# EasyEDA Pro project hardware.eprj, schematic Schematic2
Create Date: 2022-11-15; Page Name: P1; Project Name: SCH_tc264_2022-07-02; Schematic Name: Schematic2; Update Date: 2022-12-05; Company: 嘉立创EDA; Page Size: A3; Version: V1.0
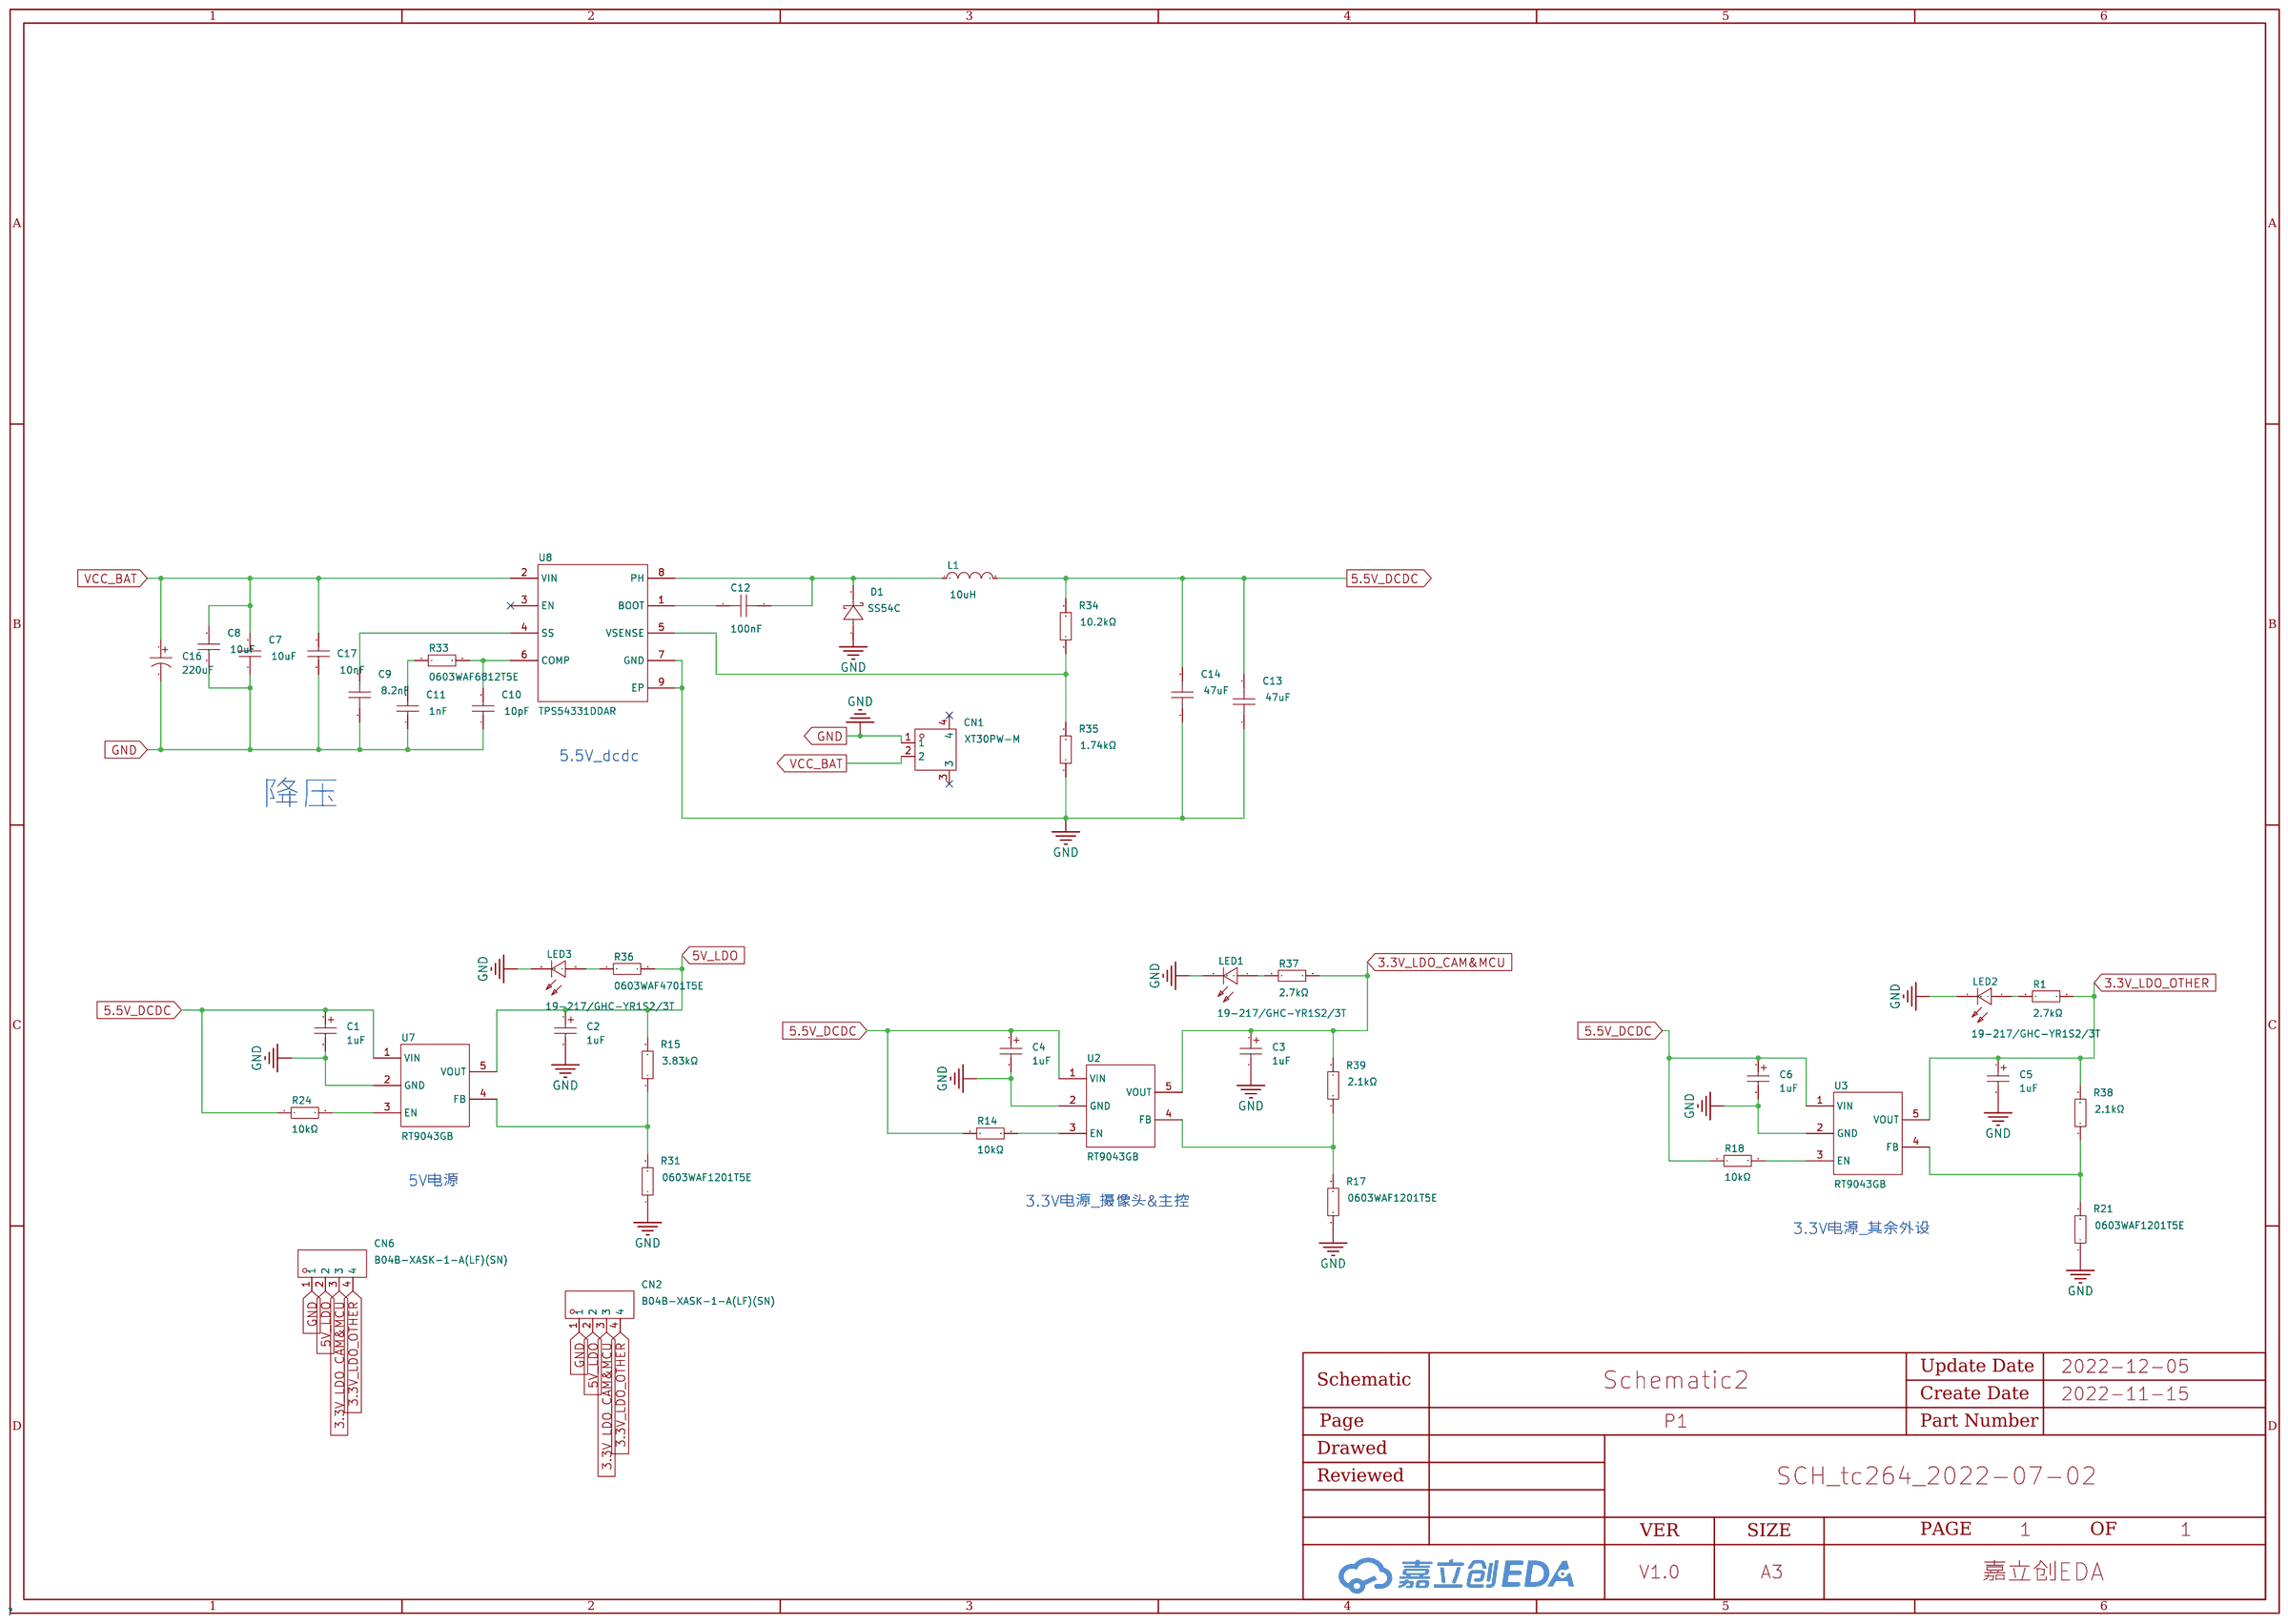
[diagram p2: schematic sheet]

## Parts
C1  1uF  [CAP-SMD_L3.2-W1.6-RD]
C2  1uF  [CAP-SMD_L3.2-W1.6-RD]
C3  1uF  [CAP-SMD_L3.2-W1.6-RD]
C4  1uF  [CAP-SMD_L3.2-W1.6-RD]
C5  1uF  [CAP-SMD_L3.2-W1.6-RD]
C6  1uF  [CAP-SMD_L3.2-W1.6-RD]
C7  10uF  [C1206]
C8  10uF  [C1206]
C9  8.2nF  [C0603]
C10  10pF  [C0402]
C11  1nF  [C0603]
C12  100nF  [C0603]
C13  47uF  [C1206]
C14  47uF  [C1206]
C16  220uF  [CAP-TH_BD10.0-P5.00-D1.0-FD]
C17  10nF  [C0603]
CN1  XT30PW-M  [CONN-TH_XT30PW-M]
CN2  B04B-XASK-1-A(LF)(SN)  [CONN-TH_B04B-XASK-1-A-LF-SN]
CN6  B04B-XASK-1-A(LF)(SN)  [CONN-TH_B04B-XASK-1-A-LF-SN]
D1  SS54C  [SMC_L6.9-W5.9-LS7.9-R-RD]
L1  10uH  [IND-SMD_L11.5-W10.0_SMMS1040]
LED1  19-217/GHC-YR1S2/3T  [LED0603-R-RD]
LED2  19-217/GHC-YR1S2/3T  [LED0603-R-RD]
LED3  19-217/GHC-YR1S2/3T  [LED0603-R-RD]
R1  2.7kΩ  [R0603]
R14  10kΩ  [R0603]
R15  3.83kΩ  [R0603]
R17  0603WAF1201T5E  [R0603]
R18  10kΩ  [R0603]
R21  0603WAF1201T5E  [R0603]
R24  10kΩ  [R0603]
R31  0603WAF1201T5E  [R0603]
R33  0603WAF6812T5E  [R0603]
R34  10.2kΩ  [R0603]
R35  1.74kΩ  [R0603]
R36  0603WAF4701T5E  [R0603]
R37  2.7kΩ  [R0603]
R38  2.1kΩ  [R0603]
R39  2.1kΩ  [R0603]
U2  RT9043GB  [SOT-23-5_L3.0-W1.7-P0.95-LS2.8-BR]
U3  RT9043GB  [SOT-23-5_L3.0-W1.7-P0.95-LS2.8-BR]
U7  RT9043GB  [SOT-23-5_L3.0-W1.7-P0.95-LS2.8-BR]
U8  TPS54331DDAR  [SOIC-8_L5.0-W4.0-P1.27-LS6.0-BL-EP2.0]

## Library data of the parts
C1-C6 = TAJA105K016RNJ: 容值:1uF;精度:±10%;额定电压:16V;等效串联电阻:-;工作温度:-55~+125;; LCSC Part Name: 1uF ±10% 16V; Supplier Part: C7174; Manufacturer: Kyocera AVX; Supplier Footprint: CASE-A_3216; JLCPCB Part Class: Extended Part; Datasheet: https://atta.szlcsc.com/upload/public/pdf/source/20160107/1457707748219.pdf; Supplier: LCSC; Tolerance: ±10%; Rated Voltage: 16V; Operating Temperature: -55~+125
C7 C8 = CL31A106KBHNNNE: 容值:10uF;精度:±10%;额定电压:50V;材质(温度系数):X5R;; LCSC Part Name: 10uF ±10% 50V; Supplier Part: C13585; Manufacturer: SAMSUNG(三星); Supplier Footprint: 1206; JLCPCB Part Class: Basic Part; Datasheet: https://atta.szlcsc.com/upload/public/pdf/source/20160103/1457707668742.pdf; Supplier: LCSC; Tolerance: ±10%; Voltage Rated: 50V; Temperature Coefficient: X5R
C9 = CC0603KRX7R9BB822: 容值:8.2nF;精度:±10%;额定电压:50V;材质(温度系数):X7R;; LCSC Part Name: 8.2nF ±10% 50V; Supplier Part: C113812; Manufacturer: YAGEO(国巨); Supplier Footprint: 0603; JLCPCB Part Class: Extended Part; Datasheet: https://atta.szlcsc.com/upload/public/pdf/source/20170602/1496384445452.pdf; Supplier: LCSC; Tolerance: ±10%; Voltage Rated: 50V; Temperature Coefficient: X7R
C10 = CC0402JRNPO9BN100: 容值:10pF;精度:±5%;额定电压:50V;材质(温度系数):NP0;; LCSC Part Name: 10pF ±5% 50V; Supplier Part: C106199; Manufacturer: YAGEO(国巨); Supplier Footprint: 0402; JLCPCB Part Class: Extended Part; Datasheet: https://atta.szlcsc.com/upload/public/pdf/source/20170518/1495085708228.pdf; Supplier: LCSC; Tolerance: ±5%; Voltage Rated: 50V; Temperature Coefficient: NP0
C11 = CC0603KRX7R9BB102: 容值:1nF;精度:±10%;额定电压:50V;材质(温度系数):X7R;; LCSC Part Name: 1nF ±10% 50V; Supplier Part: C100040; Manufacturer: YAGEO(国巨); Supplier Footprint: 0603; JLCPCB Part Class: Extended Part; Datasheet: https://atta.szlcsc.com/upload/public/pdf/source/20170420/1492670664651.pdf; Supplier: LCSC; Tolerance: ±10%; Voltage Rated: 50V; Temperature Coefficient: X7R
C12 = CC0603KRX7R9BB104: 容值:100nF;精度:±10%;额定电压:50V;材质(温度系数):X7R;; LCSC Part Name: 100nF ±10% 50V; Supplier Part: C14663; Manufacturer: YAGEO(国巨); Supplier Footprint: 0603; JLCPCB Part Class: Basic Part; Datasheet: https://atta.szlcsc.com/upload/public/pdf/source/20170116/1484561234239.pdf; Supplier: LCSC; Tolerance: ±10%; Voltage Rated: 50V; Temperature Coefficient: X7R
C13 C14 = GRM31CR61A476ME15L: 容值:47uF;精度:±20%;额定电压:10V;温度系数:X5R;; LCSC Part Name: 47uF 10V; Supplier Part: C94034; Manufacturer: muRata(村田); Supplier Footprint: 1206; JLCPCB Part Class: Extended Part; Datasheet: https://atta.szlcsc.com/upload/public/pdf/source/20170310/1489116302849.pdf; Supplier: LCSC; Tolerance: ±20%; Voltage Rated: 10V; Temperature Coefficient: X5R
C16 = KM227M050G13RR0VH2FP0: 容值:220uF;脚间距:5mm;纹波电流:-;额定电压:50V;等效串联电阻:-;精度:±20%;工作寿命:2000hrs 105;电容体直径:10mm;工作温度:-;电容体长度:13mm;; LCSC Part Name: 220uF 50V; Supplier Part: C45105; Manufacturer: CX(承兴); Supplier Footprint: 径向引线,10x13mm; JLCPCB Part Class: Extended Part; Datasheet: https://atta.szlcsc.com/upload/public/pdf/source/20151029/1457707529682.pdf; Supplier: LCSC; Lead Spacing: 5mm; Rated Voltage: 50V; Tolerance: ±20%; Lifetime @ Temp: 2000hrs 105; φD: 10mm; L: 13mm
C17 = CC0603KRX7R9BB103: 容值:10nF;精度:±10%;额定电压:50V;材质(温度系数):X7R;; LCSC Part Name: 10nF ±10% 50V; Supplier Part: C100042; Manufacturer: YAGEO(国巨); Supplier Footprint: 0603; JLCPCB Part Class: Extended Part; Datasheet: https://atta.szlcsc.com/upload/public/pdf/source/20180326/C100042_E8B0111D51DE3671A0A4A59FBCEFE81C.pdf; Supplier: LCSC; Tolerance: ±10%; Voltage Rated: 50V; Temperature Coefficient: X7R
CN1 = XT30PW-M: Socket,DCsupply,XT30,male,PIN:2; LCSC Part Name: XT30PW-M公头; Supplier Part: C431092; Manufacturer: AMASS(艾迈斯); Supplier Footprint: Through Hole; JLCPCB Part Class: Extended Part; Datasheet: https://atta.szlcsc.com/upload/public/pdf/source/20220222/6A9F22F7850E25B33E1BE430ADF8560B.pdf; Supplier: LCSC
CN2 CN6 = B04B-XASK-1-A(LF)(SN): 参考系列:XA;间距:2.5mm;插针结构:1x4P;排数:1;每排PIN数:4;行距:-;公母:公型插针;安装方式:直插;额定电流:3A;工作温度范围:-25~+85;; LCSC Part Name: 4P 脚距2.5mm; Supplier Part: C491709; Manufacturer: JST; Supplier Footprint: 插件,P=2.5mm; JLCPCB Part Class: Extended Part; Datasheet: https://atta.szlcsc.com/upload/public/pdf/source/20200416/C514162_2DCD7D1CD2019D14145B8FEA1B6236C2.pdf; Supplier: LCSC; Reference Series: XA; Pitch: 2.5mm; Pins Structure: 1x4P; Number of Rows: 1; Number of PINs Per Row: 4; Gender: 公型插针; Mounting Style: 直插; Current Rating (Max): 3A; Operating Temperature Range: -25~+85
D1 = SS54C_C908244: 二极管配置:独立式;直流反向耐压(Vr):40V;平均整流电流(Io):5A;正向压降(Vf):550mV@5A;反向电流(Ir):500uA@40V;; LCSC Part Name: 40V 5A 550mV@5A; Supplier Part: C908244; Manufacturer: FUXINSEMI(富芯森美); Supplier Footprint: SMC(DO-214AB); JLCPCB Part Class: Extended Part; Datasheet: https://atta.szlcsc.com/upload/public/pdf/source/20201027/C908242_77C8A81B3EBE52B4332ED1F80CC85D97.pdf; Supplier: LCSC; Diode Configuration: 独立式; Reverse Voltage (Vr): 40V; Average Rectified Current (Io): 5A; Forward Voltage (Vf@If): 550mV@5A; Reverse Leakage Current (Ir): 500uA@40V
L1 = MWSA1004S-100MT: 精度:±20%;直流电阻(DCR):30mΩ;额定电流:7.8A;电感值:10uH;; LCSC Part Name: 10uH ±20%; Supplier Part: C408487; Manufacturer: Sunlord(顺络); Supplier Footprint: SMD; JLCPCB Part Class: Extended Part; Datasheet: https://atta.szlcsc.com/upload/public/pdf/source/20190729/C408487_10B27C975B2F63C7424A4B34DD502902.pdf; Supplier: LCSC; Tolerance: ±20%; DC Resistance (DCR): 30mΩ; Height: 4mm; Rated Current: 7.8A; Width: 11.5mm; Length: 10mm
LED1-LED3 = 19-217/GHC-YR1S2/3T: 照明颜色:翠绿;色温 - CCT（K）:-;主波长/色坐标:520~535nm;; LCSC Part Name: 翠绿LED; Supplier Part: C72043; Manufacturer: EVERLIGHT(台湾亿光); Supplier Footprint: 0603; JLCPCB Part Class: Basic Part; Datasheet: https://atta.szlcsc.com/upload/public/pdf/source/20160507/1462613613780.pdf; Supplier: LCSC; Mounting Type: 表面贴装; Illumination Color: 翠绿; Luminous Intensity (IF=20mA): 112~258mcd; Dominant Wavelength / Coordinate rank: 520~535nm
R1 R37 = 0603WAF2701T5E: 电阻类型:厚膜电阻;阻值:2.7kΩ;精度:±1%;功率:100mW;温度系数:±100ppm/;最大工作电压:75V;工作温度范围:-55~+155;; LCSC Part Name: 2.7kΩ ±1% 100mW; Supplier Part: C13167; Manufacturer: UNI-ROYAL(厚声); Supplier Footprint: 0603; JLCPCB Part Class: Basic Part; Datasheet: https://atta.szlcsc.com/upload/public/pdf/source/20200306/C422600_1E6D84923E4A46A82E41ADD87F860B5C.pdf; Supplier: LCSC; Type: 厚膜电阻; Tolerance: ±1%; Power(Watts): 100mW; Temperature Coefficient: ±100ppm/; Overload Voltage (Max): 75V; Operating Temperature Range: -55~+155
R14 R18 R24 = 0603WAF1002T5E: 电阻类型:厚膜电阻;阻值:10kΩ;精度:±1%;功率:100mW;温度系数:±100ppm/;最大工作电压:75V;工作温度范围:-55~+155;; LCSC Part Name: 10kΩ ±1% 100mW; Supplier Part: C25804; Manufacturer: UNI-ROYAL(厚声); Supplier Footprint: 0603; JLCPCB Part Class: Basic Part; Datasheet: https://atta.szlcsc.com/upload/public/pdf/source/20200306/C422600_1E6D84923E4A46A82E41ADD87F860B5C.pdf; Supplier: LCSC; Type: 厚膜电阻; Tolerance: ±1%; Power(Watts): 100mW; Temperature Coefficient: ±100ppm/; Overload Voltage (Max): 75V; Operating Temperature Range: -55~+155
R15 = 0603WAF3831T5E: 精度:±1%;温度系数:±100ppm/;功率:1/10W;阻值:3.83kΩ;最大工作电压:75V;工作温度范围:-55~+155;; LCSC Part Name: 3.83KΩ ±1%; Supplier Part: C22982; Manufacturer: UNI-ROYAL(厚声); Supplier Footprint: 0603; JLCPCB Part Class: Extended Part; Datasheet: https://atta.szlcsc.com/upload/public/pdf/source/20170920/C22982_1505901016435982369.pdf; Supplier: LCSC; Tolerance: ±1%; Temperature Coefficient: ±100ppm/; Power(Watts): 1/10W; Overload Voltage (Max): 75V; Operating Temperature Range: -55~+155
R17 R21 R31 = 0603WAF1201T5E: LCSC Part Name: 1.2KΩ(1201) ±1% 编带; Supplier Part: C22765; Manufacturer: UNI-ROYAL(厚声); Supplier Footprint: 0603; JLCPCB Part Class: Basic Part; Datasheet: https://atta.szlcsc.com/upload/public/pdf/source/20170920/C22765_1505887453653980563.pdf; Supplier: LCSC
R33 = 0603WAF6812T5E: LCSC Part Name: 68.1KΩ(6812) ±1% 编带; Supplier Part: C25976; Manufacturer: UNI-ROYAL(厚声); Supplier Footprint: 0603; JLCPCB Part Class: Extended Part; Datasheet: https://atta.szlcsc.com/upload/public/pdf/source/20170920/C25976_1505895134985980970.pdf; Supplier: LCSC
R34 = 0603WAF1022T5E: 电阻类型:厚膜电阻;阻值:10.2kΩ;精度:±1%;功率:100mW;温度系数:±100ppm/;最大工作电压:75V;工作温度范围:-55~+155;; LCSC Part Name: 10.2kΩ ±1% 100mW; Supplier Part: C22772; Manufacturer: UNI-ROYAL(厚声); Supplier Footprint: 0603; JLCPCB Part Class: Extended Part; Datasheet: https://atta.szlcsc.com/upload/public/pdf/source/20200306/C422600_1E6D84923E4A46A82E41ADD87F860B5C.pdf; Supplier: LCSC; Type: 厚膜电阻; Tolerance: ±1%; Power(Watts): 100mW; Temperature Coefficient: ±100ppm/; Overload Voltage (Max): 75V; Operating Temperature Range: -55~+155
R35 = 0603WAF1741T5E: 电阻类型:厚膜电阻;阻值:1.74kΩ;精度:±1%;功率:1/10W;温度系数:±100ppm/;最大工作电压:75V;工作温度范围:-55~+155;; LCSC Part Name: 1.74kΩ ±1%; Supplier Part: C22848; Manufacturer: UNI-ROYAL(厚声); Supplier Footprint: 0603; JLCPCB Part Class: Extended Part; Datasheet: https://atta.szlcsc.com/upload/public/pdf/source/20200306/C422600_1E6D84923E4A46A82E41ADD87F860B5C.pdf; Supplier: LCSC; Type: 厚膜电阻; Tolerance: ±1%; Power(Watts): 1/10W; Temperature Coefficient: ±100ppm/; Overload Voltage (Max): 75V; Operating Temperature Range: -55~+155
R36 = 0603WAF4701T5E: LCSC Part Name: 4.7KΩ(4701) ±1% 编带; Supplier Part: C23162; Manufacturer: UNI-ROYAL(厚声); Supplier Footprint: 0603; JLCPCB Part Class: Basic Part; Datasheet: https://atta.szlcsc.com/upload/public/pdf/source/20170920/C23162_1505901109673982545.pdf; Supplier: LCSC
R38 R39 = 0603WAF2101T5E: 电阻类型:厚膜电阻;阻值:2.1kΩ;精度:±1%;功率:100mW;温度系数:±100ppm/;最大工作电压:75V;工作温度范围:-55~+155;; LCSC Part Name: 2.1kΩ ±1% 100mW; Supplier Part: C22902; Manufacturer: UNI-ROYAL(厚声); Supplier Footprint: 0603; JLCPCB Part Class: Extended Part; Datasheet: https://atta.szlcsc.com/upload/public/pdf/source/20200306/C422600_1E6D84923E4A46A82E41ADD87F860B5C.pdf; Supplier: LCSC; Type: 厚膜电阻; Tolerance: ±1%; Power(Watts): 100mW; Temperature Coefficient: ±100ppm/; Overload Voltage (Max): 75V; Operating Temperature Range: -55~+155
U2 U3 U7 = RT9043GB: 输出类型:可调;输出极性:正;输出通道数:1;最大输入电压:5.5V;输出电压:1.2V~5V;压差:350mV@(400mA);输出电流:400mA;电源纹波抑制比(PRSS):67dB@(1kHz),56dB@(10kHz);; LCSC Part Name: Vin=5.5V Vout=1.2V~5V 400mA 67dB@(1kHz),56dB@(10kHz); Supplier Part: C55019; Manufacturer: RICHTEK(台湾立锜); Supplier Footprint: SOT-23-5; JLCPCB Part Class: Extended Part; Datasheet: https://atta.szlcsc.com/upload/public/pdf/source/20150811/1457707342352.pdf; Supplier: LCSC; Output Type: 可调; Output Polarity: 正; Number of Outputs: 1; Maximum Input Voltage: 5.5V; Output Voltage: 1.2V~5V; Dropout Voltage: 350mV@(400mA); Output Current: 400mA; Power Supply Rejection Ratio (PRSS): 67dB@(1kHz),56dB@(10kHz)
U8 = TPS54331DDAR: 功能类型:降压型;同步整流:-;输出通道数:-;拓扑结构:-;输入电压:-;输出电流(最大值):-;开关频率:-;; LCSC Part Name: 降压型; Supplier Part: C90761; Manufacturer: TI(德州仪器); Supplier Footprint: SOIC-8-EP-150mil; JLCPCB Part Class: Extended Part; Datasheet: https://atta.szlcsc.com/upload/public/pdf/source/20171221/C90761_15138313277351195613.pdf; Supplier: LCSC; Function: 降压型

## Nets
3.3V_LDO_CAM&MCU: C3.1 CN2.3 CN6.3 R37.2 R39.2 U2.5(VOUT)
3.3V_LDO_OTHER: C5.1 CN2.4 CN6.4 R1.2 R38.2 U3.5(VOUT)
5.5V_DCDC: C1.1 C4.1 C6.1 C13.2 C14.2 L1.2 R14.1 R18.1 R24.1 R34.2 U2.1(VIN) U3.1(VIN) U7.1(VIN)
5V_LDO: C2.1 CN2.2 CN6.2 R15.2 R36.2 U7.5(VOUT)
GND: C1.2 C2.2 C3.2 C4.2 C5.2 C6.2 C7.1 C8.1 C9.1 C10.1 C11.1 C13.1 C14.1 C16.2 C17.1 CN1.1 CN2.1 CN6.1 D1.1(A) LED1.2(C) LED2.2(C) LED3.2(C) R17.1 R21.1 R31.1 R35.1 U2.2(GND) U3.2(GND) U7.2(GND) U8.7(GND) U8.9(EP)
VCC_BAT: C7.2 C8.2 C16.1 C17.2 CN1.2 U8.2(VIN)
$1N1844: C9.2 U8.4(SS)
$1N1845: C10.2 R33.2 U8.6(COMP)
$1N1846: C11.2 R33.1
$1N1849: C12.1 U8.1(BOOT)
$1N1850: C12.2 D1.2(K) L1.1 U8.8(PH)
$1N1851: R34.1 R35.2 U8.5(VSENSE)
$1N6594: R24.2 U7.3(EN)
$1N6595: R15.1 R31.2 U7.4(FB)
$1N6601: R14.2 U2.3(EN)
$1N6602: R17.2 R39.1 U2.4(FB)
$1N6610: R21.2 R38.1 U3.4(FB)
$1N6611: R18.2 U3.3(EN)
$1N12588: LED3.1(A) R36.1
$1N12747: LED1.1(A) R37.1
$1N12989: LED2.1(A) R1.1

Not connected (* = marked no-connect by the designer): CN1 3* 4*; U8 3(EN)*

## Notes on the sheet
- 5.5V_dcdc
- 降压
- 5V电源
- 3.3V电源_摄像头＆主控
- 3.3V电源_其余外设
